# Altium schematic sheet 0220_GPU GDDR6 CHANNELS.SchDoc
size 848 x 558 mm
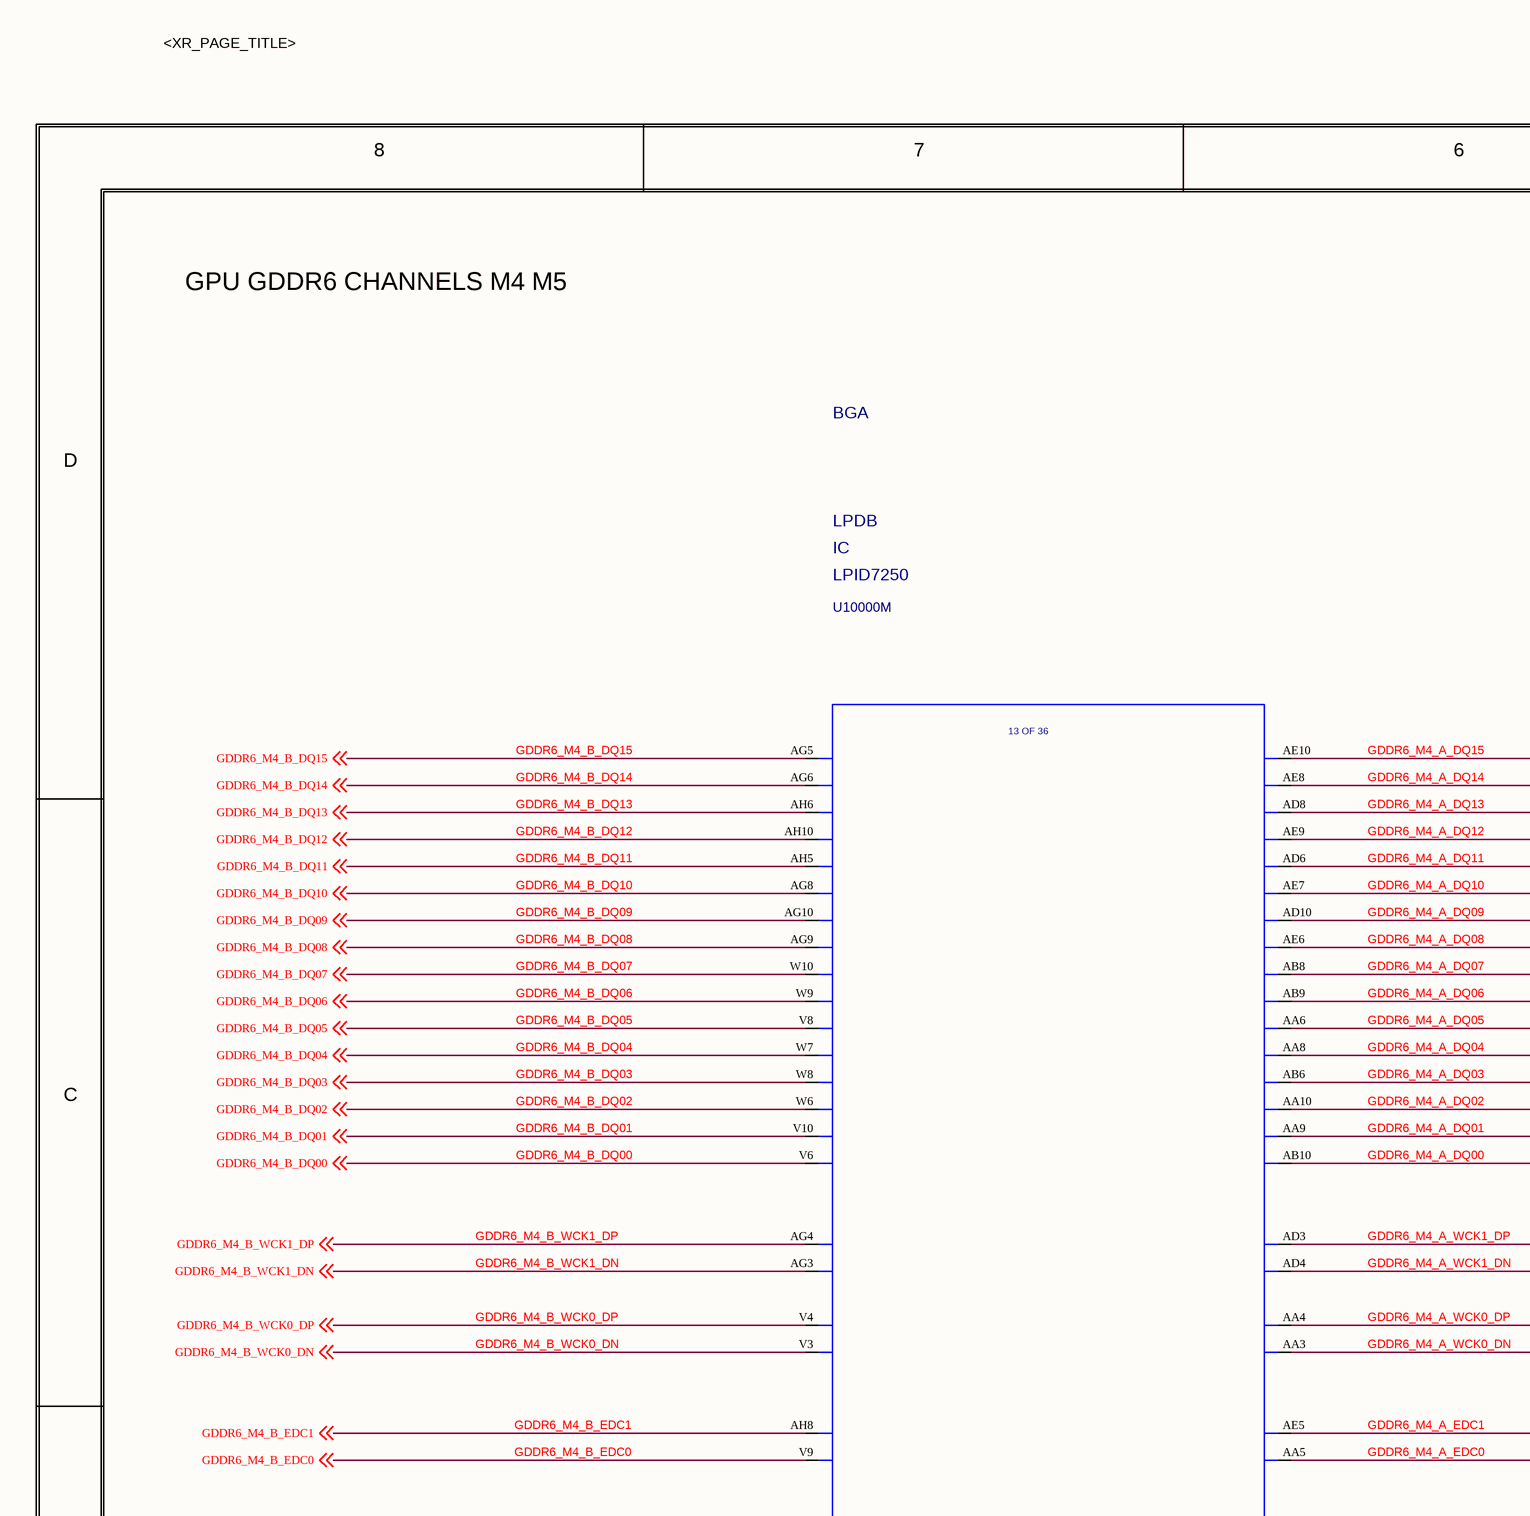
[diagram p0: 0220_GPU GDDR6 CHANNELS.SchDoc, top left]
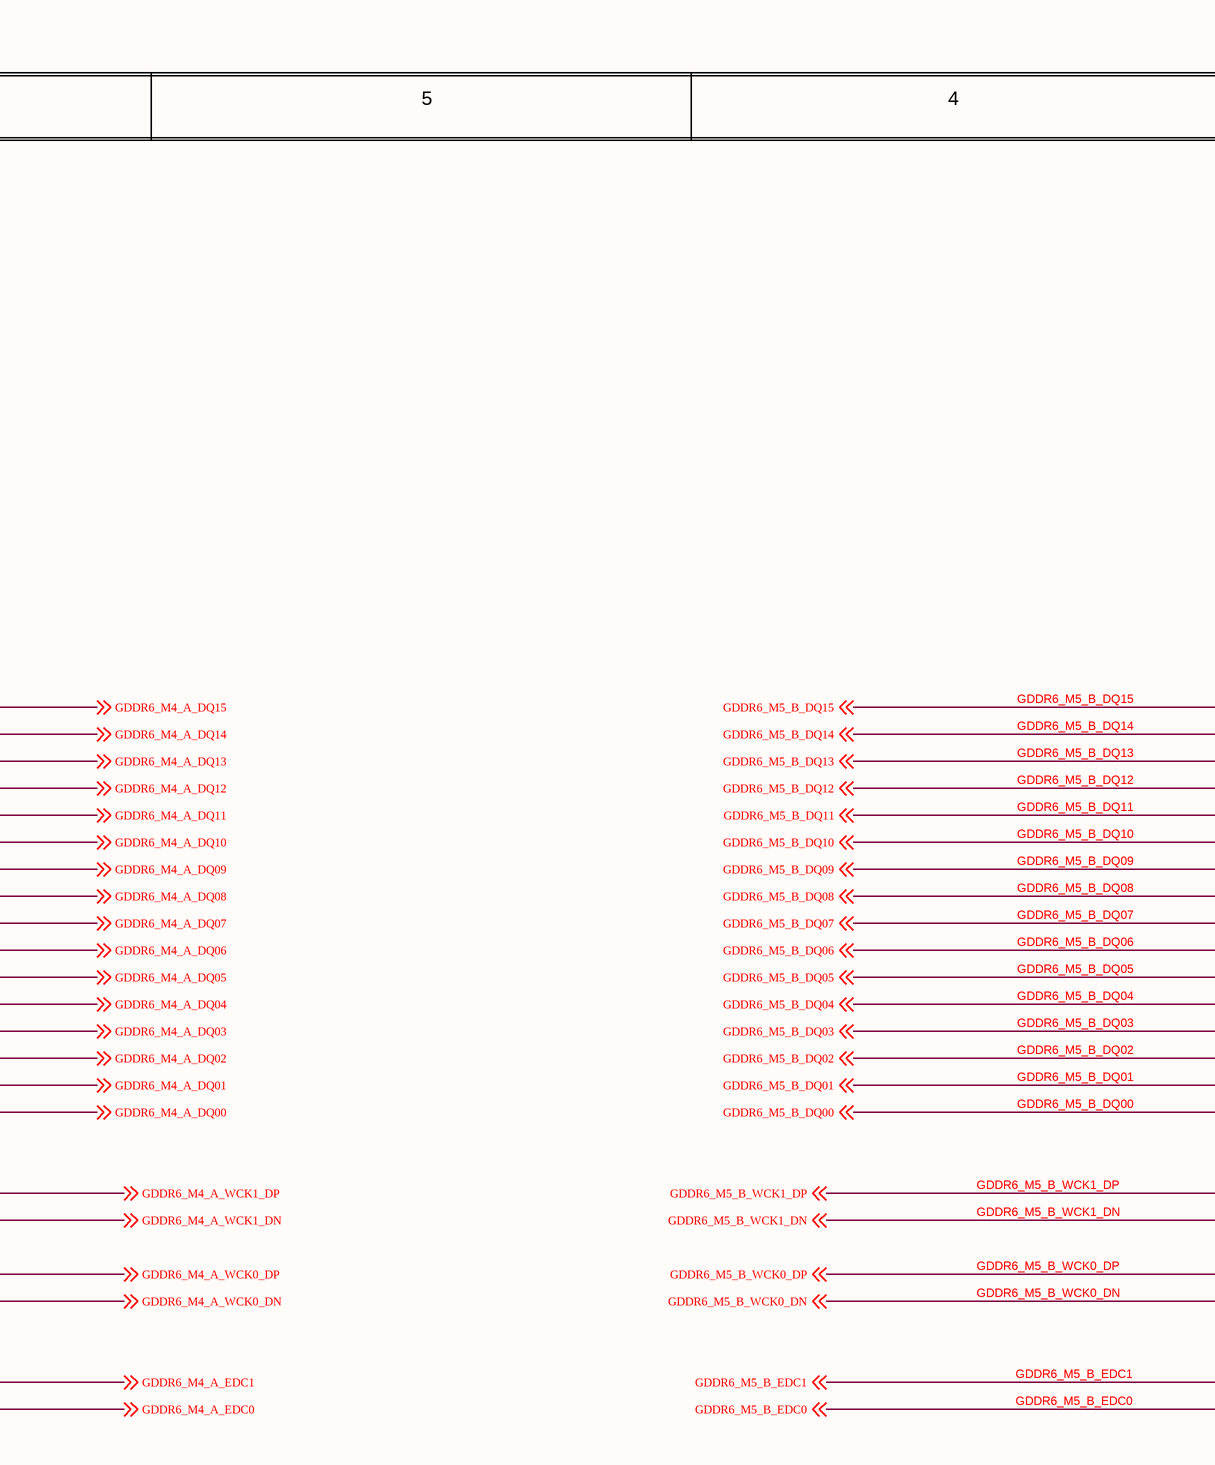
[diagram p1: 0220_GPU GDDR6 CHANNELS.SchDoc, top middle]
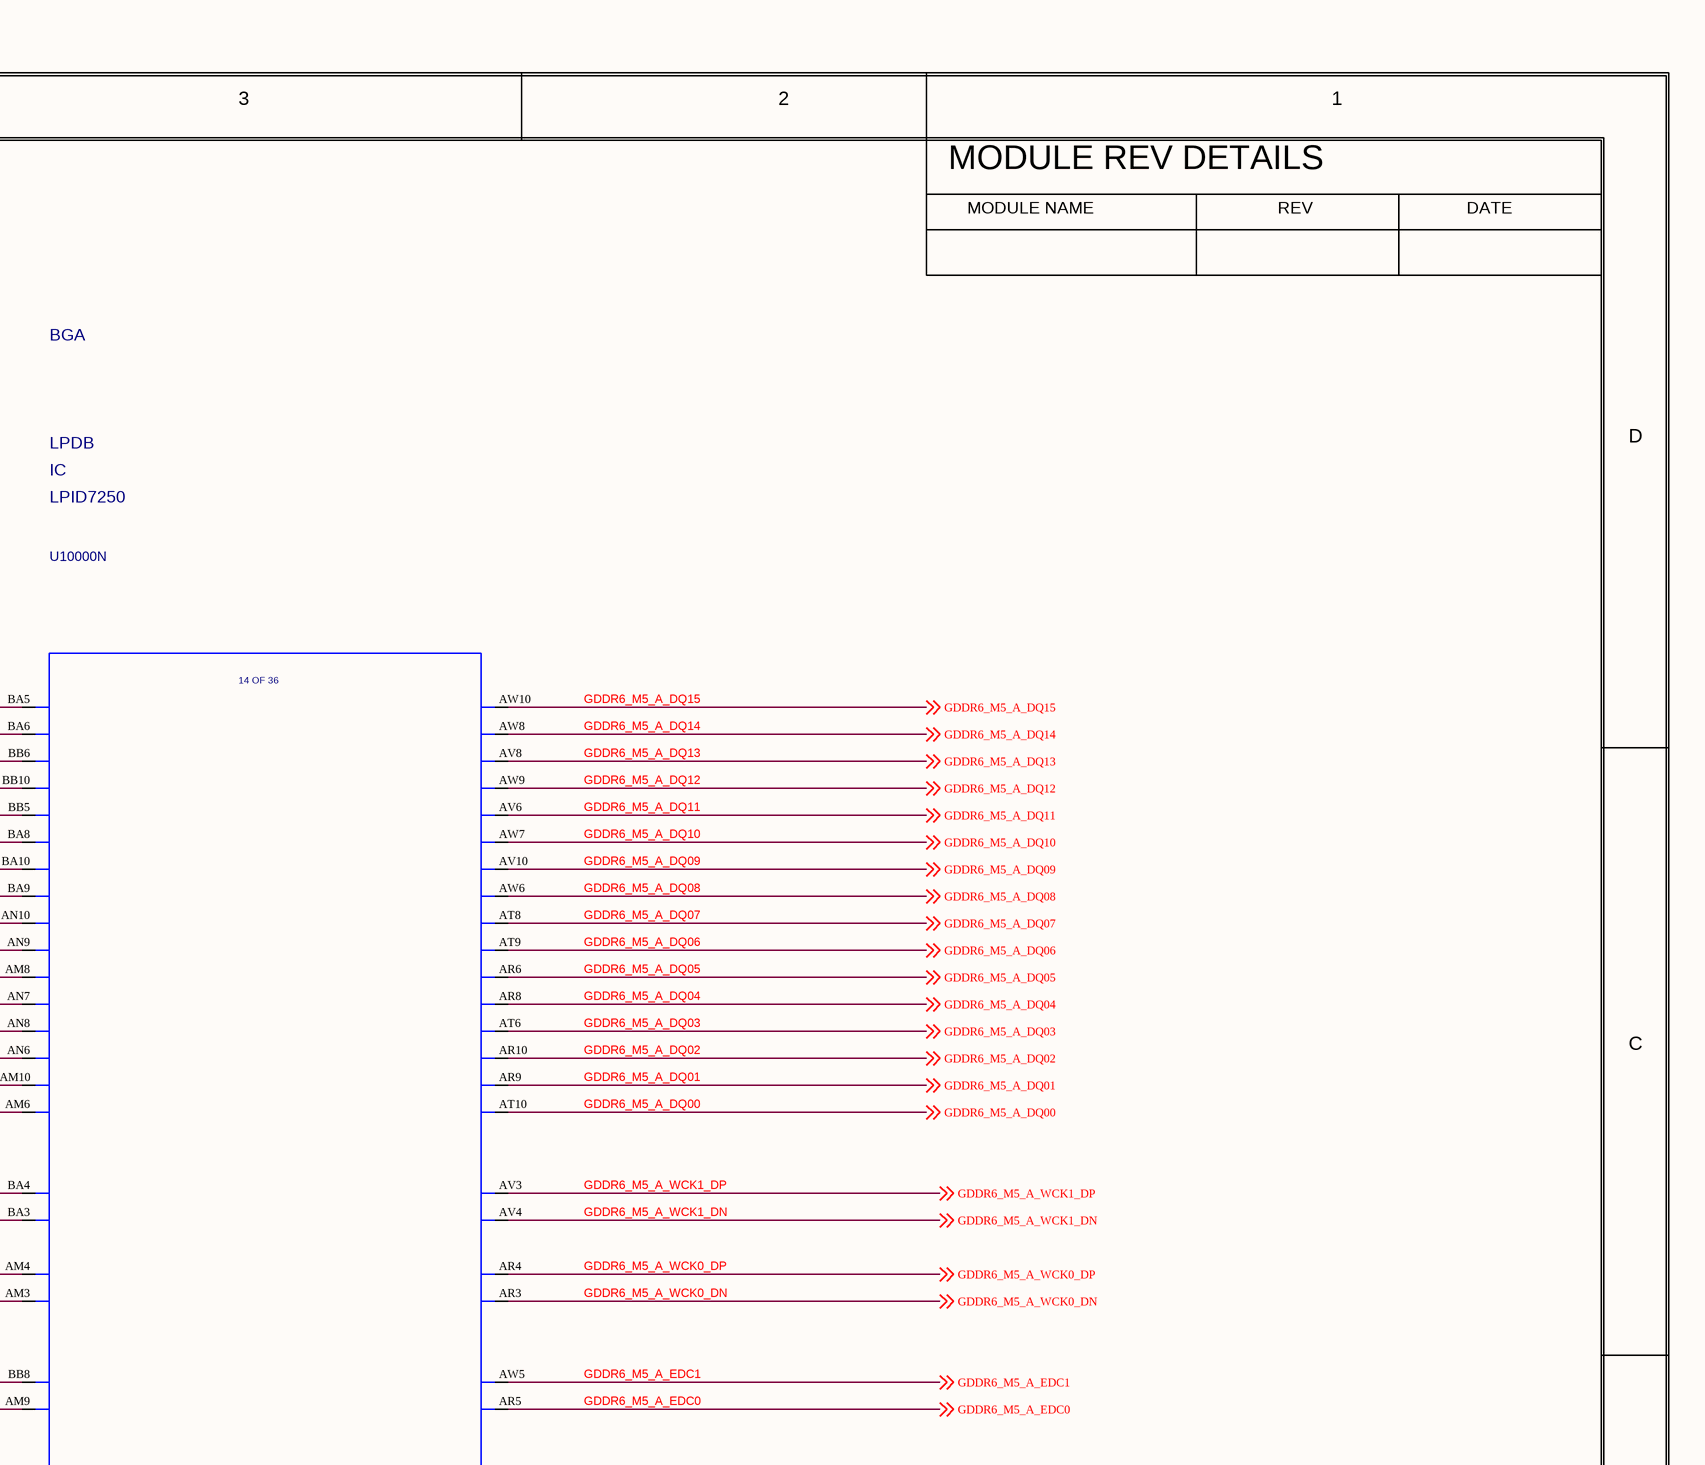
[diagram p2: 0220_GPU GDDR6 CHANNELS.SchDoc, top right]
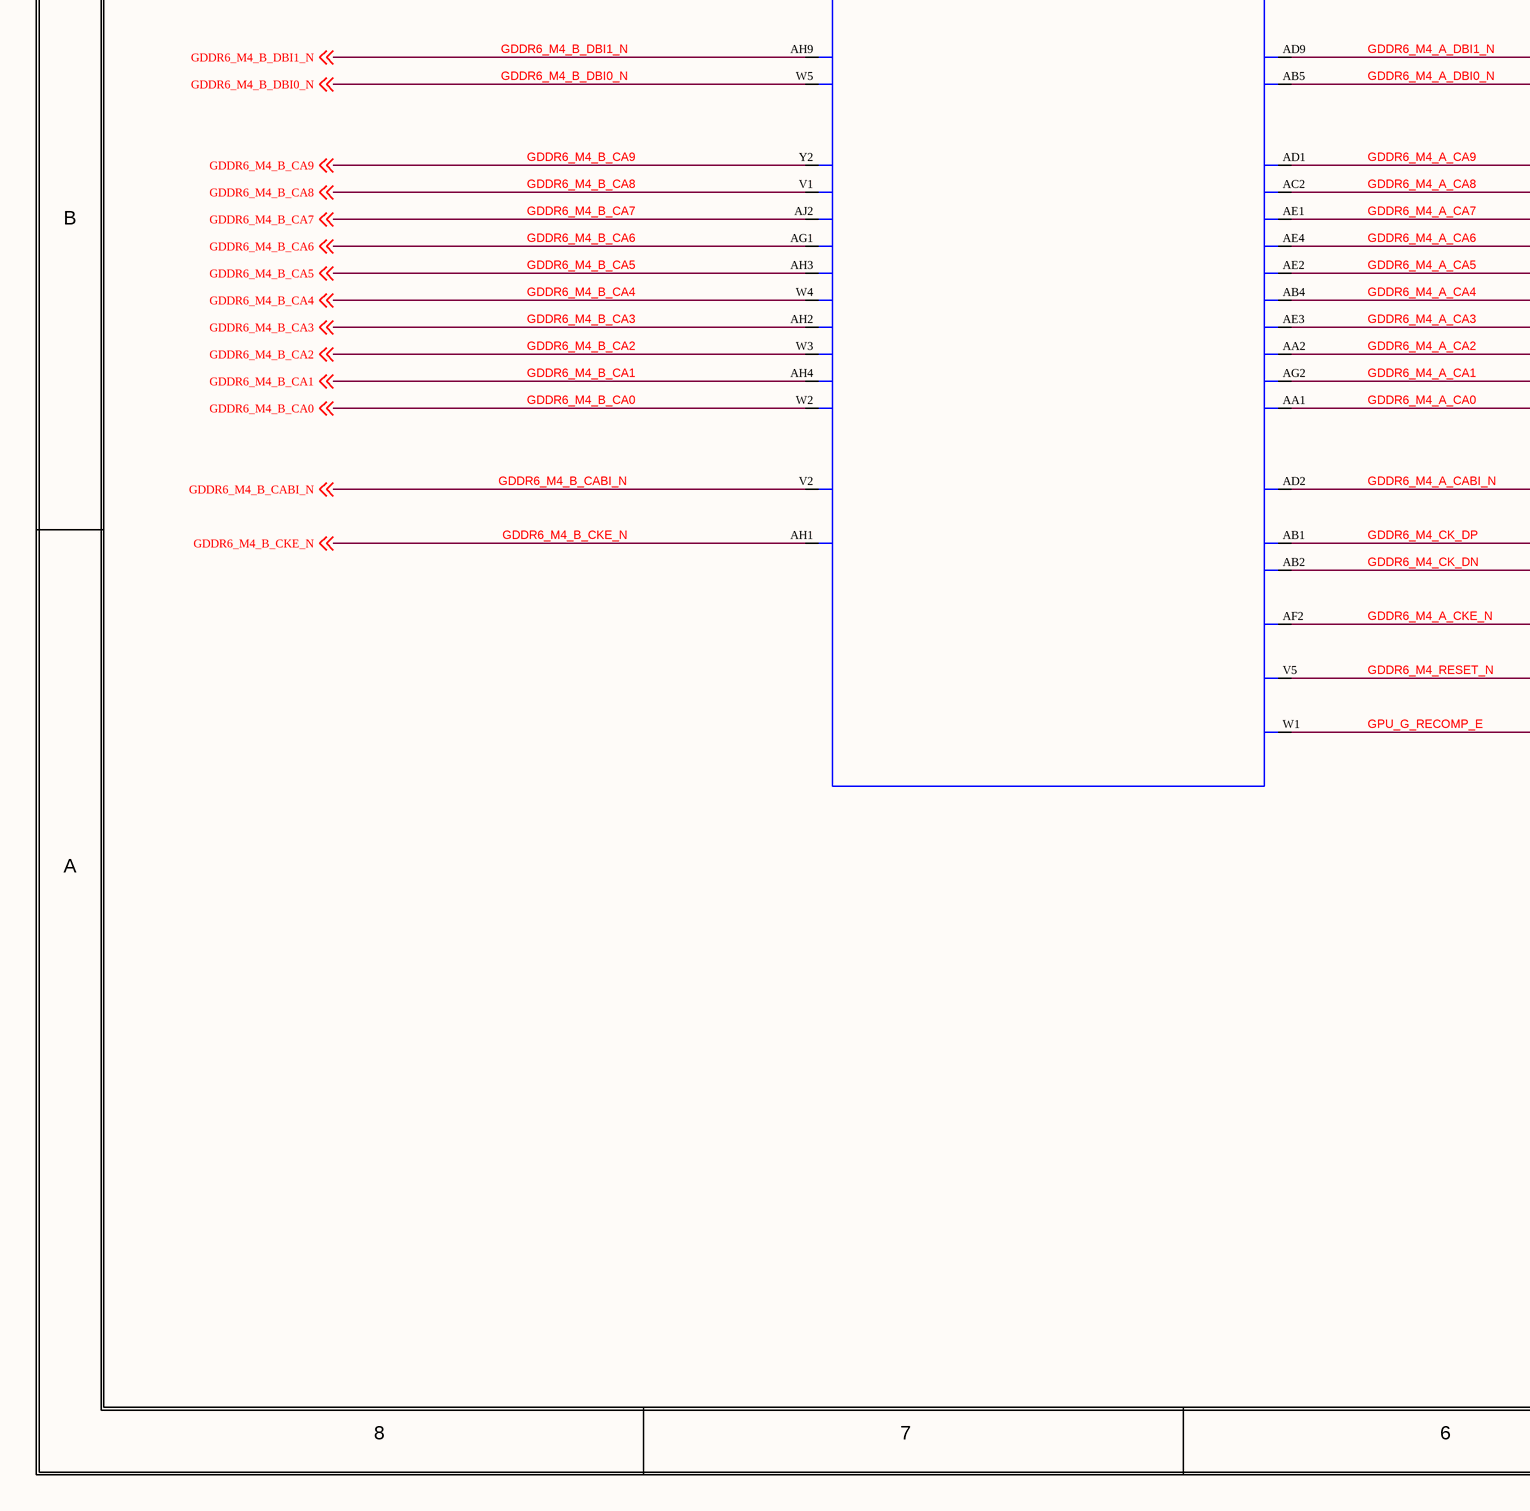
[diagram p3: 0220_GPU GDDR6 CHANNELS.SchDoc, bottom left]
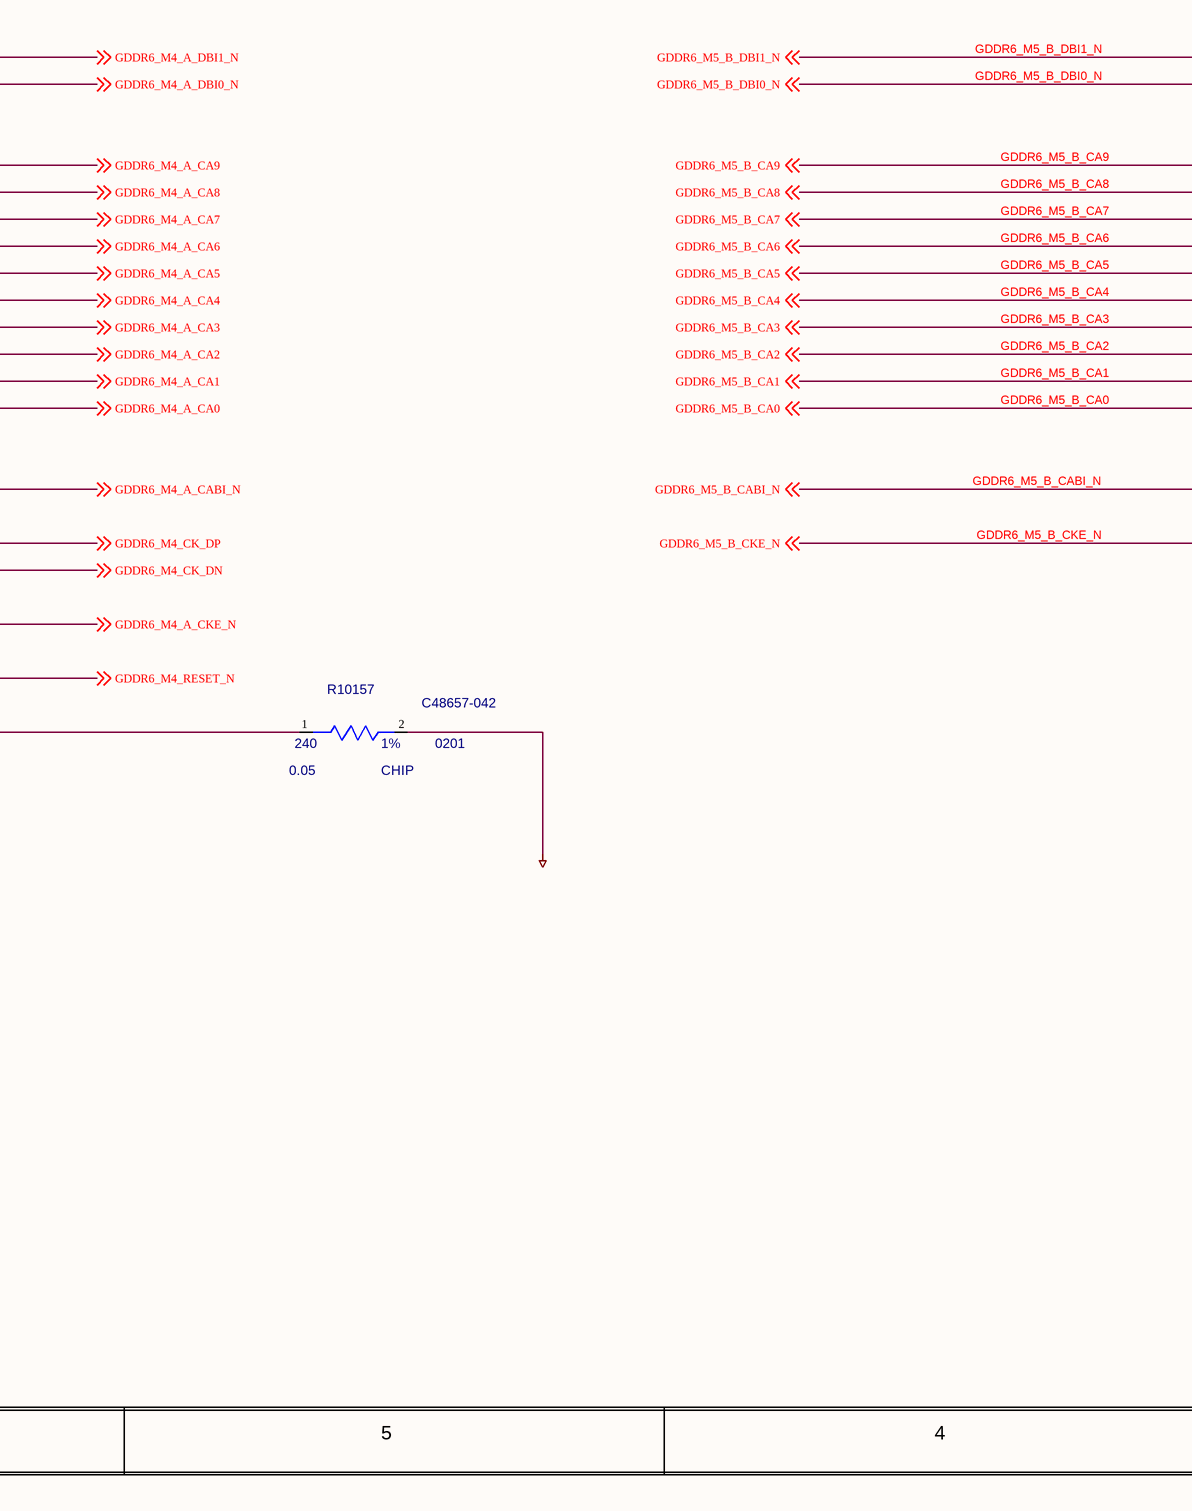
[diagram p4: 0220_GPU GDDR6 CHANNELS.SchDoc, bottom middle]
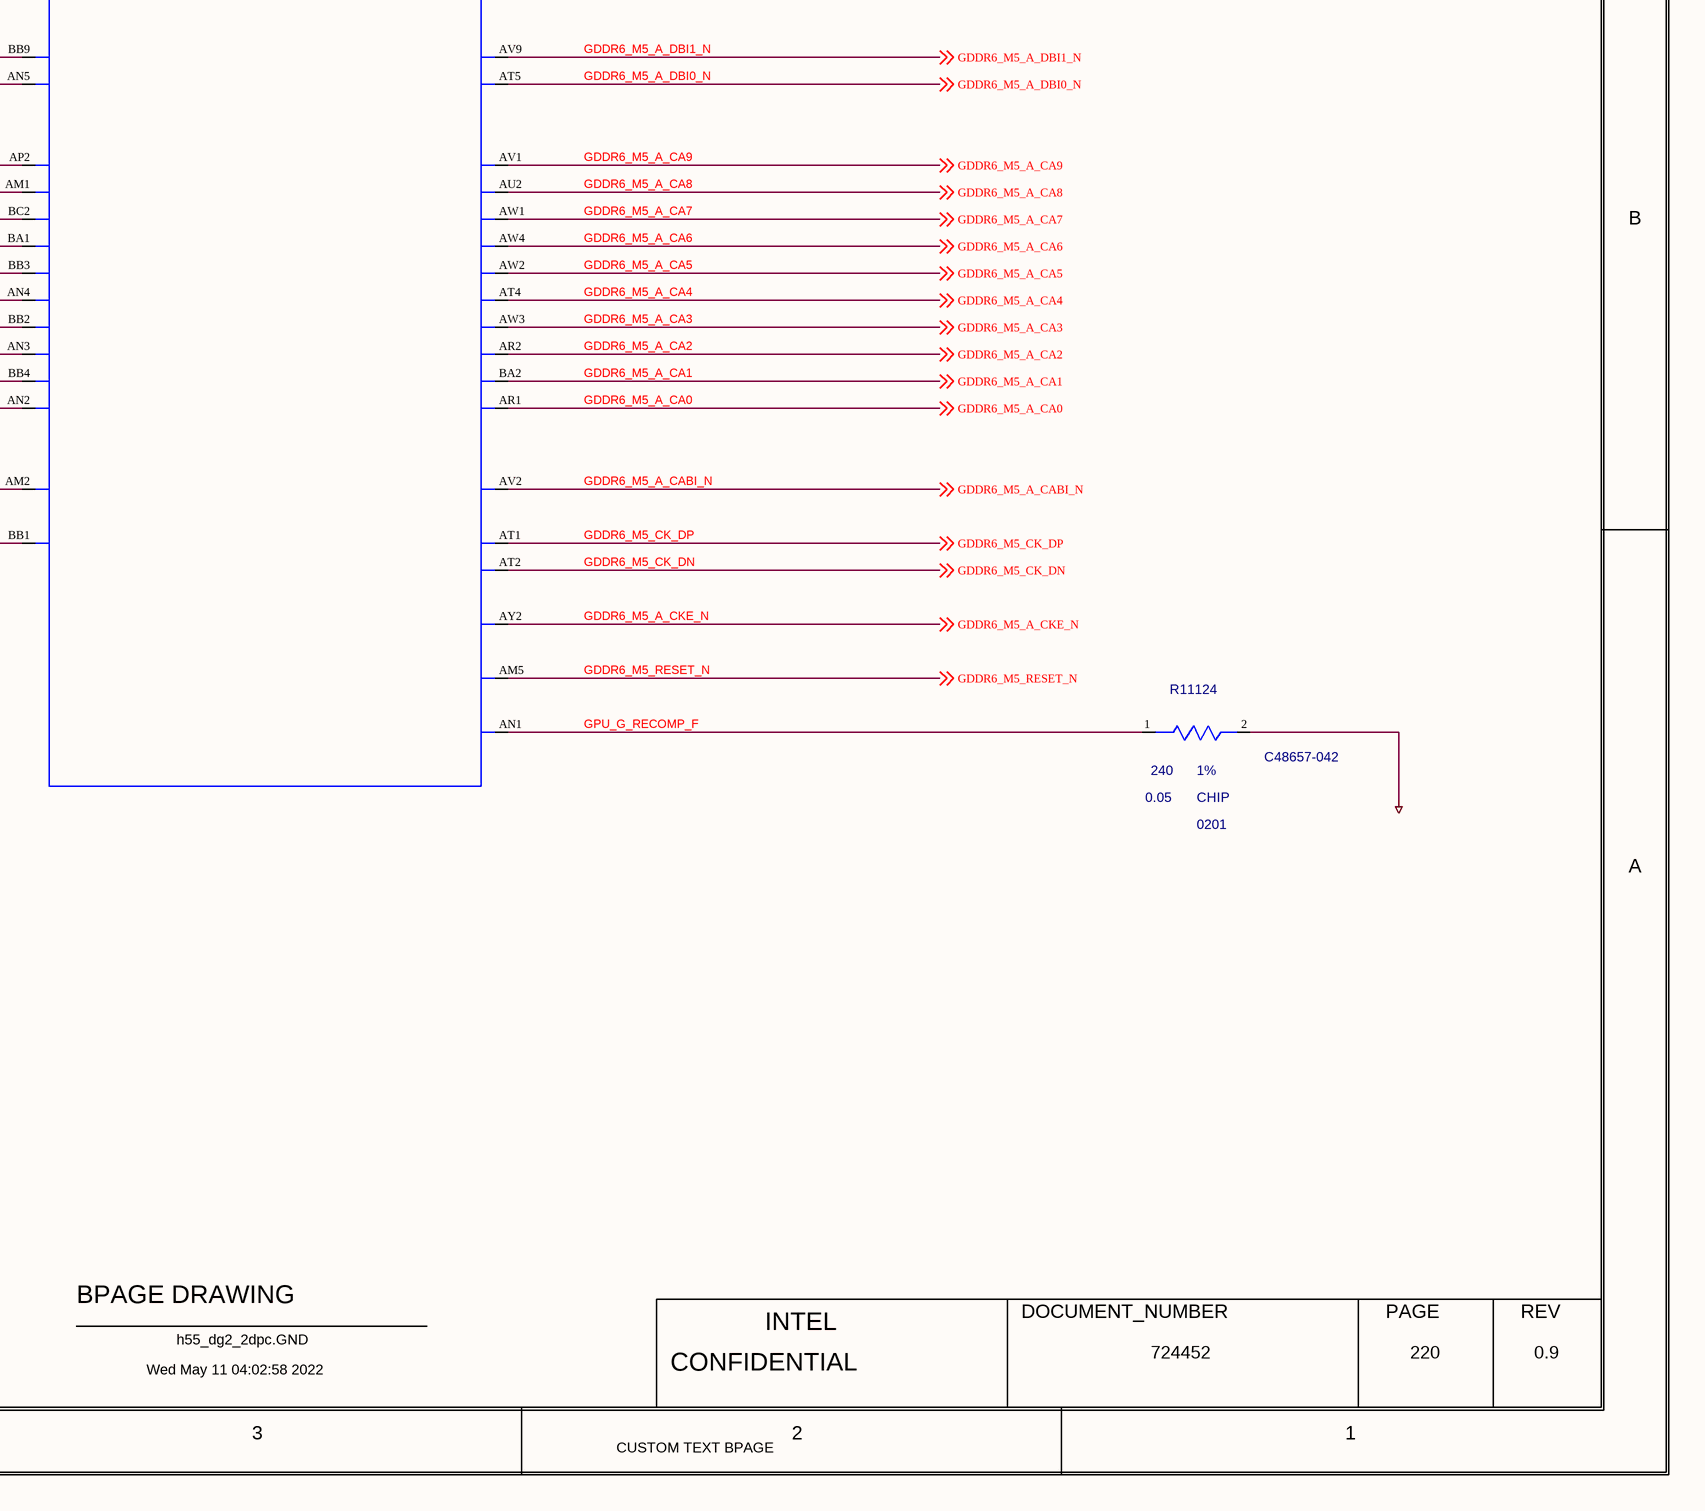
[diagram p5: 0220_GPU GDDR6 CHANNELS.SchDoc, bottom right]

## Parts
R10157  240  MATERIAL: CHIP  PACK_TYPE: 0201  PART_NUMBER: C48657-042  TOLERANCE: 1%  WATTAGE: 0.05  [SMR0201IA]
R11124  240  MATERIAL: CHIP  PACK_TYPE: 0201  PART_NUMBER: C48657-042  TOLERANCE: 1%  WATTAGE: 0.05  [SMR0201IA]
U10000  PART_NUMBER: LPID7250  PACK_TYPE: BGA  MATERIAL: IC  FP_TECH: LPDB  [CLPDB_BGA2660_DG2_SVC_512_LP7250_MA]  (hidden comment: DG2_IP_NB_SKU1_SKU2_SKU3_EXT)  (parts M,N of 36)

## Nets
GND: R10157.2(B) R11124.2(B)
GDDR6_M4_A_CA0: U10000.AA1(GDDR_C4_A_CA0) ; off-sheet GDDR6_M4_A_CA0
GDDR6_M4_A_CA1: U10000.AG2(GDDR_C4_A_CA1) ; off-sheet GDDR6_M4_A_CA1
GDDR6_M4_A_CA2: U10000.AA2(GDDR_C4_A_CA2) ; off-sheet GDDR6_M4_A_CA2
GDDR6_M4_A_CA3: U10000.AE3(GDDR_C4_A_CA3) ; off-sheet GDDR6_M4_A_CA3
GDDR6_M4_A_CA4: U10000.AB4(GDDR_C4_A_CA4) ; off-sheet GDDR6_M4_A_CA4
GDDR6_M4_A_CA5: U10000.AE2(GDDR_C4_A_CA5) ; off-sheet GDDR6_M4_A_CA5
GDDR6_M4_A_CA6: U10000.AE4(GDDR_C4_A_CA6) ; off-sheet GDDR6_M4_A_CA6
GDDR6_M4_A_CA7: U10000.AE1(GDDR_C4_A_CA7) ; off-sheet GDDR6_M4_A_CA7
GDDR6_M4_A_CA8: U10000.AC2(GDDR_C4_A_CA8) ; off-sheet GDDR6_M4_A_CA8
GDDR6_M4_A_CA9: U10000.AD1(GDDR_C4_A_CA9) ; off-sheet GDDR6_M4_A_CA9
GDDR6_M4_A_CABI_N: U10000.AD2(GDDR_C4_A_CABI_N) ; off-sheet GDDR6_M4_A_CABI_N
GDDR6_M4_A_CKE_N: U10000.AF2(GDDR_C4_A_CKE_N) ; off-sheet GDDR6_M4_A_CKE_N
GDDR6_M4_A_DBI0_N: U10000.AB5(GDDR_C4_A_DBI0_N) ; off-sheet GDDR6_M4_A_DBI0_N
GDDR6_M4_A_DBI1_N: U10000.AD9(GDDR_C4_A_DBI1_N) ; off-sheet GDDR6_M4_A_DBI1_N
GDDR6_M4_A_DQ00: U10000.AB10(GDDR_C4_A_DQ0) ; off-sheet GDDR6_M4_A_DQ00
GDDR6_M4_A_DQ01: U10000.AA9(GDDR_C4_A_DQ1) ; off-sheet GDDR6_M4_A_DQ01
GDDR6_M4_A_DQ02: U10000.AA10(GDDR_C4_A_DQ2) ; off-sheet GDDR6_M4_A_DQ02
GDDR6_M4_A_DQ03: U10000.AB6(GDDR_C4_A_DQ3) ; off-sheet GDDR6_M4_A_DQ03
GDDR6_M4_A_DQ04: U10000.AA8(GDDR_C4_A_DQ4) ; off-sheet GDDR6_M4_A_DQ04
GDDR6_M4_A_DQ05: U10000.AA6(GDDR_C4_A_DQ5) ; off-sheet GDDR6_M4_A_DQ05
GDDR6_M4_A_DQ06: U10000.AB9(GDDR_C4_A_DQ6) ; off-sheet GDDR6_M4_A_DQ06
GDDR6_M4_A_DQ07: U10000.AB8(GDDR_C4_A_DQ7) ; off-sheet GDDR6_M4_A_DQ07
GDDR6_M4_A_DQ08: U10000.AE6(GDDR_C4_A_DQ8) ; off-sheet GDDR6_M4_A_DQ08
GDDR6_M4_A_DQ09: U10000.AD10(GDDR_C4_A_DQ9) ; off-sheet GDDR6_M4_A_DQ09
GDDR6_M4_A_DQ10: U10000.AE7(GDDR_C4_A_DQ10) ; off-sheet GDDR6_M4_A_DQ10
GDDR6_M4_A_DQ11: U10000.AD6(GDDR_C4_A_DQ11) ; off-sheet GDDR6_M4_A_DQ11
GDDR6_M4_A_DQ12: U10000.AE9(GDDR_C4_A_DQ12) ; off-sheet GDDR6_M4_A_DQ12
GDDR6_M4_A_DQ13: U10000.AD8(GDDR_C4_A_DQ13) ; off-sheet GDDR6_M4_A_DQ13
GDDR6_M4_A_DQ14: U10000.AE8(GDDR_C4_A_DQ14) ; off-sheet GDDR6_M4_A_DQ14
GDDR6_M4_A_DQ15: U10000.AE10(GDDR_C4_A_DQ15) ; off-sheet GDDR6_M4_A_DQ15
GDDR6_M4_A_EDC0: U10000.AA5(GDDR_C4_A_EDC0) ; off-sheet GDDR6_M4_A_EDC0
GDDR6_M4_A_EDC1: U10000.AE5(GDDR_C4_A_EDC1) ; off-sheet GDDR6_M4_A_EDC1
GDDR6_M4_A_WCK0_DN: U10000.AA3(GDDR_C4_A_WCK0_DN) ; off-sheet GDDR6_M4_A_WCK0_DN
GDDR6_M4_A_WCK0_DP: U10000.AA4(GDDR_C4_A_WCK0_DP) ; off-sheet GDDR6_M4_A_WCK0_DP
GDDR6_M4_A_WCK1_DN: U10000.AD4(GDDR_C4_A_WCK1_DN) ; off-sheet GDDR6_M4_A_WCK1_DN
GDDR6_M4_A_WCK1_DP: U10000.AD3(GDDR_C4_A_WCK1_DP) ; off-sheet GDDR6_M4_A_WCK1_DP
GDDR6_M4_B_CA0: U10000.W2(GDDR_C4_B_CA0) ; off-sheet GDDR6_M4_B_CA0
GDDR6_M4_B_CA1: U10000.AH4(GDDR_C4_B_CA1) ; off-sheet GDDR6_M4_B_CA1
GDDR6_M4_B_CA2: U10000.W3(GDDR_C4_B_CA2) ; off-sheet GDDR6_M4_B_CA2
GDDR6_M4_B_CA3: U10000.AH2(GDDR_C4_B_CA3) ; off-sheet GDDR6_M4_B_CA3
GDDR6_M4_B_CA4: U10000.W4(GDDR_C4_B_CA4) ; off-sheet GDDR6_M4_B_CA4
GDDR6_M4_B_CA5: U10000.AH3(GDDR_C4_B_CA5) ; off-sheet GDDR6_M4_B_CA5
GDDR6_M4_B_CA6: U10000.AG1(GDDR_C4_B_CA6) ; off-sheet GDDR6_M4_B_CA6
GDDR6_M4_B_CA7: U10000.AJ2(GDDR_C4_B_CA7) ; off-sheet GDDR6_M4_B_CA7
GDDR6_M4_B_CA8: U10000.V1(GDDR_C4_B_CA8) ; off-sheet GDDR6_M4_B_CA8
GDDR6_M4_B_CA9: U10000.Y2(GDDR_C4_B_CA9) ; off-sheet GDDR6_M4_B_CA9
GDDR6_M4_B_CABI_N: U10000.V2(GDDR_C4_B_CABI_N) ; off-sheet GDDR6_M4_B_CABI_N
GDDR6_M4_B_CKE_N: U10000.AH1(GDDR_C4_B_CKE_N) ; off-sheet GDDR6_M4_B_CKE_N
GDDR6_M4_B_DBI0_N: U10000.W5(GDDR_C4_B_DBI0_N) ; off-sheet GDDR6_M4_B_DBI0_N
GDDR6_M4_B_DBI1_N: U10000.AH9(GDDR_C4_B_DBI1_N) ; off-sheet GDDR6_M4_B_DBI1_N
GDDR6_M4_B_DQ00: U10000.V6(GDDR_C4_B_DQ0) ; off-sheet GDDR6_M4_B_DQ00
GDDR6_M4_B_DQ01: U10000.V10(GDDR_C4_B_DQ1) ; off-sheet GDDR6_M4_B_DQ01
GDDR6_M4_B_DQ02: U10000.W6(GDDR_C4_B_DQ2) ; off-sheet GDDR6_M4_B_DQ02
GDDR6_M4_B_DQ03: U10000.W8(GDDR_C4_B_DQ3) ; off-sheet GDDR6_M4_B_DQ03
GDDR6_M4_B_DQ04: U10000.W7(GDDR_C4_B_DQ4) ; off-sheet GDDR6_M4_B_DQ04
GDDR6_M4_B_DQ05: U10000.V8(GDDR_C4_B_DQ5) ; off-sheet GDDR6_M4_B_DQ05
GDDR6_M4_B_DQ06: U10000.W9(GDDR_C4_B_DQ6) ; off-sheet GDDR6_M4_B_DQ06
GDDR6_M4_B_DQ07: U10000.W10(GDDR_C4_B_DQ7) ; off-sheet GDDR6_M4_B_DQ07
GDDR6_M4_B_DQ08: U10000.AG9(GDDR_C4_B_DQ8) ; off-sheet GDDR6_M4_B_DQ08
GDDR6_M4_B_DQ09: U10000.AG10(GDDR_C4_B_DQ9) ; off-sheet GDDR6_M4_B_DQ09
GDDR6_M4_B_DQ10: U10000.AG8(GDDR_C4_B_DQ10) ; off-sheet GDDR6_M4_B_DQ10
GDDR6_M4_B_DQ11: U10000.AH5(GDDR_C4_B_DQ11) ; off-sheet GDDR6_M4_B_DQ11
GDDR6_M4_B_DQ12: U10000.AH10(GDDR_C4_B_DQ12) ; off-sheet GDDR6_M4_B_DQ12
GDDR6_M4_B_DQ13: U10000.AH6(GDDR_C4_B_DQ13) ; off-sheet GDDR6_M4_B_DQ13
GDDR6_M4_B_DQ14: U10000.AG6(GDDR_C4_B_DQ14) ; off-sheet GDDR6_M4_B_DQ14
GDDR6_M4_B_DQ15: U10000.AG5(GDDR_C4_B_DQ15) ; off-sheet GDDR6_M4_B_DQ15
GDDR6_M4_B_EDC0: U10000.V9(GDDR_C4_B_EDC0) ; off-sheet GDDR6_M4_B_EDC0
GDDR6_M4_B_EDC1: U10000.AH8(GDDR_C4_B_EDC1) ; off-sheet GDDR6_M4_B_EDC1
GDDR6_M4_B_WCK0_DN: U10000.V3(GDDR_C4_B_WCK0_DN) ; off-sheet GDDR6_M4_B_WCK0_DN
GDDR6_M4_B_WCK0_DP: U10000.V4(GDDR_C4_B_WCK0_DP) ; off-sheet GDDR6_M4_B_WCK0_DP
GDDR6_M4_B_WCK1_DN: U10000.AG3(GDDR_C4_B_WCK1_DN) ; off-sheet GDDR6_M4_B_WCK1_DN
GDDR6_M4_B_WCK1_DP: U10000.AG4(GDDR_C4_B_WCK1_DP) ; off-sheet GDDR6_M4_B_WCK1_DP
GDDR6_M4_CK_DN: U10000.AB2(GDDR_C4_CK_DN) ; off-sheet GDDR6_M4_CK_DN
GDDR6_M4_CK_DP: U10000.AB1(GDDR_C4_CK_DP) ; off-sheet GDDR6_M4_CK_DP
GDDR6_M4_RESET_N: U10000.V5(GDDR_C4_RESET_N) ; off-sheet GDDR6_M4_RESET_N
GDDR6_M5_A_CA0: U10000.AR1(GDDR_C5_A_CA0) ; off-sheet GDDR6_M5_A_CA0
GDDR6_M5_A_CA1: U10000.BA2(GDDR_C5_A_CA1) ; off-sheet GDDR6_M5_A_CA1
GDDR6_M5_A_CA2: U10000.AR2(GDDR_C5_A_CA2) ; off-sheet GDDR6_M5_A_CA2
GDDR6_M5_A_CA3: U10000.AW3(GDDR_C5_A_CA3) ; off-sheet GDDR6_M5_A_CA3
GDDR6_M5_A_CA4: U10000.AT4(GDDR_C5_A_CA4) ; off-sheet GDDR6_M5_A_CA4
GDDR6_M5_A_CA5: U10000.AW2(GDDR_C5_A_CA5) ; off-sheet GDDR6_M5_A_CA5
GDDR6_M5_A_CA6: U10000.AW4(GDDR_C5_A_CA6) ; off-sheet GDDR6_M5_A_CA6
GDDR6_M5_A_CA7: U10000.AW1(GDDR_C5_A_CA7) ; off-sheet GDDR6_M5_A_CA7
GDDR6_M5_A_CA8: U10000.AU2(GDDR_C5_A_CA8) ; off-sheet GDDR6_M5_A_CA8
GDDR6_M5_A_CA9: U10000.AV1(GDDR_C5_A_CA9) ; off-sheet GDDR6_M5_A_CA9
GDDR6_M5_A_CABI_N: U10000.AV2(GDDR_C5_A_CABI_N) ; off-sheet GDDR6_M5_A_CABI_N
GDDR6_M5_A_CKE_N: U10000.AY2(GDDR_C5_A_CKE_N) ; off-sheet GDDR6_M5_A_CKE_N
GDDR6_M5_A_DBI0_N: U10000.AT5(GDDR_C5_A_DBI0_N) ; off-sheet GDDR6_M5_A_DBI0_N
GDDR6_M5_A_DBI1_N: U10000.AV9(GDDR_C5_A_DBI1_N) ; off-sheet GDDR6_M5_A_DBI1_N
GDDR6_M5_A_DQ00: U10000.AT10(GDDR_C5_A_DQ0) ; off-sheet GDDR6_M5_A_DQ00
GDDR6_M5_A_DQ01: U10000.AR9(GDDR_C5_A_DQ1) ; off-sheet GDDR6_M5_A_DQ01
GDDR6_M5_A_DQ02: U10000.AR10(GDDR_C5_A_DQ2) ; off-sheet GDDR6_M5_A_DQ02
GDDR6_M5_A_DQ03: U10000.AT6(GDDR_C5_A_DQ3) ; off-sheet GDDR6_M5_A_DQ03
GDDR6_M5_A_DQ04: U10000.AR8(GDDR_C5_A_DQ4) ; off-sheet GDDR6_M5_A_DQ04
GDDR6_M5_A_DQ05: U10000.AR6(GDDR_C5_A_DQ5) ; off-sheet GDDR6_M5_A_DQ05
GDDR6_M5_A_DQ06: U10000.AT9(GDDR_C5_A_DQ6) ; off-sheet GDDR6_M5_A_DQ06
GDDR6_M5_A_DQ07: U10000.AT8(GDDR_C5_A_DQ7) ; off-sheet GDDR6_M5_A_DQ07
GDDR6_M5_A_DQ08: U10000.AW6(GDDR_C5_A_DQ8) ; off-sheet GDDR6_M5_A_DQ08
GDDR6_M5_A_DQ09: U10000.AV10(GDDR_C5_A_DQ9) ; off-sheet GDDR6_M5_A_DQ09
GDDR6_M5_A_DQ10: U10000.AW7(GDDR_C5_A_DQ10) ; off-sheet GDDR6_M5_A_DQ10
GDDR6_M5_A_DQ11: U10000.AV6(GDDR_C5_A_DQ11) ; off-sheet GDDR6_M5_A_DQ11
GDDR6_M5_A_DQ12: U10000.AW9(GDDR_C5_A_DQ12) ; off-sheet GDDR6_M5_A_DQ12
GDDR6_M5_A_DQ13: U10000.AV8(GDDR_C5_A_DQ13) ; off-sheet GDDR6_M5_A_DQ13
GDDR6_M5_A_DQ14: U10000.AW8(GDDR_C5_A_DQ14) ; off-sheet GDDR6_M5_A_DQ14
GDDR6_M5_A_DQ15: U10000.AW10(GDDR_C5_A_DQ15) ; off-sheet GDDR6_M5_A_DQ15
GDDR6_M5_A_EDC0: U10000.AR5(GDDR_C5_A_EDC0) ; off-sheet GDDR6_M5_A_EDC0
GDDR6_M5_A_EDC1: U10000.AW5(GDDR_C5_A_EDC1) ; off-sheet GDDR6_M5_A_EDC1
GDDR6_M5_A_WCK0_DN: U10000.AR3(GDDR_C5_A_WCK0_DN) ; off-sheet GDDR6_M5_A_WCK0_DN
GDDR6_M5_A_WCK0_DP: U10000.AR4(GDDR_C5_A_WCK0_DP) ; off-sheet GDDR6_M5_A_WCK0_DP
GDDR6_M5_A_WCK1_DN: U10000.AV4(GDDR_C5_A_WCK1_DN) ; off-sheet GDDR6_M5_A_WCK1_DN
GDDR6_M5_A_WCK1_DP: U10000.AV3(GDDR_C5_A_WCK1_DP) ; off-sheet GDDR6_M5_A_WCK1_DP
GDDR6_M5_B_CA0: U10000.AN2(GDDR_C5_B_CA0) ; off-sheet GDDR6_M5_B_CA0
GDDR6_M5_B_CA1: U10000.BB4(GDDR_C5_B_CA1) ; off-sheet GDDR6_M5_B_CA1
GDDR6_M5_B_CA2: U10000.AN3(GDDR_C5_B_CA2) ; off-sheet GDDR6_M5_B_CA2
GDDR6_M5_B_CA3: U10000.BB2(GDDR_C5_B_CA3) ; off-sheet GDDR6_M5_B_CA3
GDDR6_M5_B_CA4: U10000.AN4(GDDR_C5_B_CA4) ; off-sheet GDDR6_M5_B_CA4
GDDR6_M5_B_CA5: U10000.BB3(GDDR_C5_B_CA5) ; off-sheet GDDR6_M5_B_CA5
GDDR6_M5_B_CA6: U10000.BA1(GDDR_C5_B_CA6) ; off-sheet GDDR6_M5_B_CA6
GDDR6_M5_B_CA7: U10000.BC2(GDDR_C5_B_CA7) ; off-sheet GDDR6_M5_B_CA7
GDDR6_M5_B_CA8: U10000.AM1(GDDR_C5_B_CA8) ; off-sheet GDDR6_M5_B_CA8
GDDR6_M5_B_CA9: U10000.AP2(GDDR_C5_B_CA9) ; off-sheet GDDR6_M5_B_CA9
GDDR6_M5_B_CABI_N: U10000.AM2(GDDR_C5_B_CABI_N) ; off-sheet GDDR6_M5_B_CABI_N
GDDR6_M5_B_CKE_N: U10000.BB1(GDDR_C5_B_CKE_N) ; off-sheet GDDR6_M5_B_CKE_N
GDDR6_M5_B_DBI0_N: U10000.AN5(GDDR_C5_B_DBI0_N) ; off-sheet GDDR6_M5_B_DBI0_N
GDDR6_M5_B_DBI1_N: U10000.BB9(GDDR_C5_B_DBI1_N) ; off-sheet GDDR6_M5_B_DBI1_N
GDDR6_M5_B_DQ00: U10000.AM6(GDDR_C5_B_DQ0) ; off-sheet GDDR6_M5_B_DQ00
GDDR6_M5_B_DQ01: U10000.AM10(GDDR_C5_B_DQ1) ; off-sheet GDDR6_M5_B_DQ01
GDDR6_M5_B_DQ02: U10000.AN6(GDDR_C5_B_DQ2) ; off-sheet GDDR6_M5_B_DQ02
GDDR6_M5_B_DQ03: U10000.AN8(GDDR_C5_B_DQ3) ; off-sheet GDDR6_M5_B_DQ03
GDDR6_M5_B_DQ04: U10000.AN7(GDDR_C5_B_DQ4) ; off-sheet GDDR6_M5_B_DQ04
GDDR6_M5_B_DQ05: U10000.AM8(GDDR_C5_B_DQ5) ; off-sheet GDDR6_M5_B_DQ05
GDDR6_M5_B_DQ06: U10000.AN9(GDDR_C5_B_DQ6) ; off-sheet GDDR6_M5_B_DQ06
GDDR6_M5_B_DQ07: U10000.AN10(GDDR_C5_B_DQ7) ; off-sheet GDDR6_M5_B_DQ07
GDDR6_M5_B_DQ08: U10000.BA9(GDDR_C5_B_DQ8) ; off-sheet GDDR6_M5_B_DQ08
GDDR6_M5_B_DQ09: U10000.BA10(GDDR_C5_B_DQ9) ; off-sheet GDDR6_M5_B_DQ09
GDDR6_M5_B_DQ10: U10000.BA8(GDDR_C5_B_DQ10) ; off-sheet GDDR6_M5_B_DQ10
GDDR6_M5_B_DQ11: U10000.BB5(GDDR_C5_B_DQ11) ; off-sheet GDDR6_M5_B_DQ11
GDDR6_M5_B_DQ12: U10000.BB10(GDDR_C5_B_DQ12) ; off-sheet GDDR6_M5_B_DQ12
GDDR6_M5_B_DQ13: U10000.BB6(GDDR_C5_B_DQ13) ; off-sheet GDDR6_M5_B_DQ13
GDDR6_M5_B_DQ14: U10000.BA6(GDDR_C5_B_DQ14) ; off-sheet GDDR6_M5_B_DQ14
GDDR6_M5_B_DQ15: U10000.BA5(GDDR_C5_B_DQ15) ; off-sheet GDDR6_M5_B_DQ15
GDDR6_M5_B_EDC0: U10000.AM9(GDDR_C5_B_EDC0) ; off-sheet GDDR6_M5_B_EDC0
GDDR6_M5_B_EDC1: U10000.BB8(GDDR_C5_B_EDC1) ; off-sheet GDDR6_M5_B_EDC1
GDDR6_M5_B_WCK0_DN: U10000.AM3(GDDR_C5_B_WCK0_DN) ; off-sheet GDDR6_M5_B_WCK0_DN
GDDR6_M5_B_WCK0_DP: U10000.AM4(GDDR_C5_B_WCK0_DP) ; off-sheet GDDR6_M5_B_WCK0_DP
GDDR6_M5_B_WCK1_DN: U10000.BA3(GDDR_C5_B_WCK1_DN) ; off-sheet GDDR6_M5_B_WCK1_DN
GDDR6_M5_B_WCK1_DP: U10000.BA4(GDDR_C5_B_WCK1_DP) ; off-sheet GDDR6_M5_B_WCK1_DP
GDDR6_M5_CK_DN: U10000.AT2(GDDR_C5_CK_DN) ; off-sheet GDDR6_M5_CK_DN
GDDR6_M5_CK_DP: U10000.AT1(GDDR_C5_CK_DP) ; off-sheet GDDR6_M5_CK_DP
GDDR6_M5_RESET_N: U10000.AM5(GDDR_C5_RESET_N) ; off-sheet GDDR6_M5_RESET_N
GPU_G_RECOMP_E: R10157.1(A) U10000.W1(GDDR_RCOMP_E)
GPU_G_RECOMP_F: R11124.1(A) U10000.AN1(GDDR_RCOMP_F)

## Notes on the sheet
- <XR_PAGE_TITLE>
- 8
- 7
- 6
- 5
- 4
- 3
- 2
- 1
- MODULE REV DETAILS
- GPU GDDR6 CHANNELS M4 M5
- MODULE NAME
- REV
- DATE
- D
- C
- B
- A
- BPAGE DRAWING
- INTEL
- DOCUMENT_NUMBER
- PAGE
- Wed May 11 04:02:58 2022
- h55_dg2_2dpc.GND
- CONFIDENTIAL
- 724452
- 220
- 0.9
- CUSTOM TEXT BPAGE
- (in symbol DG2_IP_NB_SKU1_SKU2_SKU3_EXT, part M) 13 OF 36
- (in symbol DG2_IP_NB_SKU1_SKU2_SKU3_EXT, part N) 14 OF 36

## Library data of the parts
R10157 = RES#1: CHIPS_PART_NAME: RES; CDS_PHYS_PART_NAME: RES_0201-C48657-042,CHIP,240,1%,0.05,LPDB,GENERIC; OriginalSymbolOrigin: (-75,25); XY: (-1375,6500); VER: 1; ROT: 0; PHYS_PAGE: 220; LOCATION: R10157; IP: GENERIC; FP_TECH: LPDB; DRAWING: @RVP1_ADL_SB_ADP_S_DDR5_SODIMM_2DPC_LIB.H55_DG2_2DPC(SCH_1):PAGE391; CDS_LIB: discrete; PCB Footprint: SMR0201IA; CDS_PART_NAME: RES_0201-C48657-042,CHIP,240,1%,0.05,LPDB,GENERIC; CDS_LOCATION: R10157
R11124 = RES#1: CHIPS_PART_NAME: RES; CDS_PHYS_PART_NAME: RES_0201-C48657-042,CHIP,240,1%,0.05,LPDB,GENERIC; OriginalSymbolOrigin: (-75,25); XY: (2450,6500); VER: 1; ROT: 0; PHYS_PAGE: 220; LOCATION: R11124; IP: GENERIC; FP_TECH: LPDB; DRAWING: @RVP1_ADL_SB_ADP_S_DDR5_SODIMM_2DPC_LIB.H55_DG2_2DPC(SCH_1):PAGE391; CDS_LIB: discrete; PCB Footprint: SMR0201IA; CDS_PART_NAME: RES_0201-C48657-042,CHIP,240,1%,0.05,LPDB,GENERIC; CDS_LOCATION: R11124
U10000 = DG2_IP_NB_SKU1_SKU2_SKU3_EXT: MANUF: INTEL CORP; CDS_PHYS_PART_NAME: DG2_IP_NB_SKU1_SKU2_SKU3_EXT_BGA-LPID7250,IC,DG2_IP_NB_SKU1_SKUA; CDS_LMAN_SYM_OUTLINE: -300,850,300,-800; OriginalSymbolOrigin: (-325,850); CaptureCellPackProp: DG2_IP_NB_SKU1_SKU2_SKU3_EXTM; XY: (-3050,7850); VER: 13; ROT: 0; PHYS_PAGE: 220; MFG_PN: NONE; LOCATION: U10000; DRAWING: @RVP1_ADL_SB_ADP_S_DDR5_SODIMM_2DPC_LIB.H55_DG2_2DPC(SCH_1):PAGE391; CDS_LIB: rvp1_adl_sb_adp_s_ddr5_sodimm_2dpc_lib; BMAP_REV: 1.0; PCB Footprint: CLPDB_BGA2660_DG2_SVC_512_LP7250_MA; SEC_TYPE: BGA; CHIPS_PART_NAME: DG2_IP_NB_SKU1_SKU2_SKU3_EXT; CDS_PART_NAME: DG2_IP_NB_SKU1_SKU2_SKU3_EXT_BGA-LPID7250,IC,DG2_IP_NB_SKU1_SKUA; CDS_LOCATION: U10000